# EAGLE board Resistor_Resistor (EAGLE 8.3.0), part 24 of 32
## Placement (x,y rotation side) (continued)
R29212  10K  [0201]  203.35,7.98 0 top
R29213  10K  [0201]  203.35,8.59 0 top
R29214  10K  [0201]  203.35,9.19 0 top
R29215  10K  [0201]  203.35,9.8 0 top
R29216  10K  [0201]  203.35,10.41 0 top
R29217  10K  [0201]  203.35,11.02 0 top
R29218  10K  [0201]  203.35,11.63 0 top
R29219  10K  [0201]  203.35,12.24 0 top
R29220  10K  [0201]  203.35,12.85 0 top
R29221  10K  [0201]  203.35,13.46 0 top
R29222  10K  [0201]  203.35,14.07 0 top
R29223  10K  [0201]  203.35,14.68 0 top
R29224  10K  [0201]  203.35,15.29 0 top
R29225  10K  [0201]  203.35,15.9 0 top
R29226  10K  [0201]  203.35,16.51 0 top
R29227  10K  [0201]  203.35,17.12 0 top
R29228  10K  [0201]  203.35,17.73 0 top
R29229  10K  [0201]  203.35,18.34 0 top
R29230  10K  [0201]  203.35,18.95 0 top
R29231  10K  [0201]  203.35,19.56 0 top
R29232  10K  [0201]  203.35,20.17 0 top
R29233  10K  [0201]  203.35,20.78 0 top
R29234  10K  [0201]  203.35,21.39 0 top
R29235  10K  [0201]  203.35,22 0 top
R29236  10K  [0201]  203.35,22.61 0 top
R29237  10K  [0201]  203.35,23.22 0 top
R29238  10K  [0201]  203.35,23.83 0 top
R29239  10K  [0201]  203.35,24.43 0 top
R29240  10K  [0201]  203.35,25.04 0 top
R29241  10K  [0201]  203.35,25.65 0 top
R29242  10K  [0201]  203.35,26.26 0 top
R29243  10K  [0201]  203.35,26.87 0 top
R29244  10K  [0201]  203.35,27.48 0 top
R29245  10K  [0201]  203.35,28.09 0 top
R29246  10K  [0201]  203.35,28.7 0 top
R29247  10K  [0201]  203.35,29.31 0 top
R29248  10K  [0201]  203.35,29.92 0 top
R29249  10K  [0201]  203.35,30.53 0 top
R29250  10K  [0201]  203.35,31.14 0 top
R29251  10K  [0201]  203.35,31.75 0 top
R29252  10K  [0201]  203.35,32.36 0 top
R29253  10K  [0201]  203.35,32.97 0 top
R29254  10K  [0201]  203.35,33.58 0 top
R29255  10K  [0201]  203.35,34.19 0 top
R29256  10K  [0201]  203.35,34.8 0 top
R29257  10K  [0201]  203.35,35.41 0 top
R29258  10K  [0201]  203.35,36.02 0 top
R29259  10K  [0201]  203.35,36.63 0 top
R29260  10K  [0201]  203.35,37.24 0 top
R29261  10K  [0201]  203.35,37.85 0 top
R29262  10K  [0201]  203.35,38.46 0 top
R29263  10K  [0201]  203.35,39.07 0 top
R29264  10K  [0201]  203.35,39.67 0 top
R29265  10K  [0201]  203.35,40.28 0 top
R29266  10K  [0201]  203.35,40.89 0 top
R29267  10K  [0201]  203.35,41.5 0 top
R29268  10K  [0201]  203.35,42.11 0 top
R29269  10K  [0201]  203.35,42.72 0 top
R29270  10K  [0201]  203.35,43.33 0 top
R29271  10K  [0201]  203.35,43.94 0 top
R29272  10K  [0201]  203.35,44.55 0 top
R29273  10K  [0201]  203.35,45.16 0 top
R29274  10K  [0201]  203.35,45.77 0 top
R29275  10K  [0201]  203.35,46.38 0 top
R29276  10K  [0201]  203.35,46.99 0 top
R29277  10K  [0201]  203.35,47.6 0 top
R29278  10K  [0201]  203.35,48.21 0 top
R29279  10K  [0201]  203.35,48.82 0 top
R29280  10K  [0201]  203.35,49.43 0 top
R29281  10K  [0201]  203.35,50.04 0 top
R29282  10K  [0201]  203.35,50.65 0 top
R29283  10K  [0201]  203.35,51.26 0 top
R29284  10K  [0201]  203.35,51.87 0 top
R29285  10K  [0201]  203.35,52.48 0 top
R29286  10K  [0201]  203.35,53.09 0 top
R29287  10K  [0201]  203.35,53.7 0 top
R29288  10K  [0201]  203.35,54.31 0 top
R29289  10K  [0201]  203.35,54.91 0 top
R29290  10K  [0201]  203.35,55.52 0 top
R29291  10K  [0201]  203.35,56.13 0 top
R29292  10K  [0201]  203.35,56.74 0 top
R29293  10K  [0201]  203.35,57.35 0 top
R29294  10K  [0201]  203.35,57.96 0 top
R29295  10K  [0201]  203.35,58.57 0 top
R29296  10K  [0201]  203.35,59.18 0 top
R29297  10K  [0201]  203.35,59.79 0 top
R29298  10K  [0201]  203.35,60.4 0 top
R29299  10K  [0201]  203.35,61.01 0 top
R29300  10K  [0201]  203.35,61.62 0 top
R29301  10K  [0201]  203.35,62.23 0 top
R29302  10K  [0201]  203.35,62.84 0 top
R29303  10K  [0201]  203.35,63.45 0 top
R29304  10K  [0201]  203.35,64.06 0 top
R29305  10K  [0201]  203.35,64.67 0 top
R29306  10K  [0201]  203.35,65.28 0 top
R29307  10K  [0201]  203.35,65.89 0 top
R29308  10K  [0201]  203.35,66.5 0 top
R29309  10K  [0201]  203.35,67.11 0 top
R29310  10K  [0201]  203.35,67.72 0 top
R29311  10K  [0201]  203.35,68.33 0 top
R29312  10K  [0201]  203.35,68.94 0 top
R29313  10K  [0201]  203.35,69.55 0 top
R29314  10K  [0201]  203.35,70.15 0 top
R29315  10K  [0201]  203.35,70.76 0 top
R29316  10K  [0201]  203.35,71.37 0 top
R29317  10K  [0201]  203.35,71.98 0 top
R29318  10K  [0201]  203.35,72.59 0 top
R29319  10K  [0201]  203.35,73.2 0 top
R29320  10K  [0201]  203.35,73.81 0 top
R29321  10K  [0201]  203.35,74.42 0 top
R29322  10K  [0201]  203.35,75.03 0 top
R29323  10K  [0201]  203.35,75.64 0 top
R29324  10K  [0201]  203.35,76.25 0 top
R29325  10K  [0201]  203.35,76.86 0 top
R29326  10K  [0201]  203.35,77.47 0 top
R29327  10K  [0201]  203.35,78.08 0 top
R29328  10K  [0201]  203.35,78.69 0 top
R29329  10K  [0201]  203.35,79.3 0 top
R29330  10K  [0201]  203.35,79.91 0 top
R29331  10K  [0201]  203.35,80.52 0 top
R29332  10K  [0201]  203.35,81.13 0 top
R29333  10K  [0201]  203.35,81.74 0 top
R29334  10K  [0201]  203.35,82.35 0 top
R29335  10K  [0201]  203.35,82.96 0 top
R29336  10K  [0201]  203.35,83.57 0 top
R29337  10K  [0201]  203.35,84.18 0 top
R29338  10K  [0201]  203.35,84.79 0 top
R29339  10K  [0201]  203.35,85.39 0 top
R29340  10K  [0201]  203.35,86 0 top
R29341  10K  [0201]  203.35,86.61 0 top
R29342  10K  [0201]  203.35,87.22 0 top
R29343  10K  [0201]  203.35,87.83 0 top
R29344  10K  [0201]  203.35,88.44 0 top
R29345  10K  [0201]  203.35,89.05 0 top
R29346  10K  [0201]  203.35,89.66 0 top
R29347  10K  [0201]  203.35,90.27 0 top
R29348  10K  [0201]  203.35,90.88 0 top
R29349  10K  [0201]  203.35,91.49 0 top
R29350  10K  [0201]  203.35,92.1 0 top
R29351  10K  [0201]  203.35,92.71 0 top
R29352  10K  [0201]  203.35,93.32 0 top
R29353  10K  [0201]  203.35,93.93 0 top
R29354  10K  [0201]  203.35,94.54 0 top
R29355  10K  [0201]  203.35,95.15 0 top
R29356  10K  [0201]  203.35,95.76 0 top
R29357  10K  [0201]  203.35,96.37 0 top
R29358  10K  [0201]  203.35,96.98 0 top
R29359  10K  [0201]  203.35,97.59 0 top
R29360  10K  [0201]  203.35,98.2 0 top
R29361  10K  [0201]  203.35,98.81 0 top
R29362  10K  [0201]  203.35,99.42 0 top
R29363  10K  [0201]  203.35,100.03 0 top
R29364  10K  [0201]  203.35,100.63 0 top
R29365  10K  [0201]  203.35,101.24 0 top
R29366  10K  [0201]  203.35,101.85 0 top
R29367  10K  [0201]  203.35,102.46 0 top
R29368  10K  [0201]  203.35,103.07 0 top
R29369  10K  [0201]  203.35,103.68 0 top
R29370  10K  [0201]  203.35,104.29 0 top
R29371  10K  [0201]  203.35,104.9 0 top
R29372  10K  [0201]  203.35,105.51 0 top
R29373  10K  [0201]  203.35,106.12 0 top
R29374  10K  [0201]  203.35,106.73 0 top
R29375  10K  [0201]  203.35,107.34 0 top
R29376  10K  [0201]  203.35,107.95 0 top
R29377  10K  [0201]  203.35,108.56 0 top
R29378  10K  [0201]  203.35,109.17 0 top
R29379  10K  [0201]  203.35,109.78 0 top
R29380  10K  [0201]  203.35,110.39 0 top
R29381  10K  [0201]  203.35,111 0 top
R29382  10K  [0201]  203.35,111.61 0 top
R29383  10K  [0201]  203.35,112.22 0 top
R29384  10K  [0201]  203.35,112.83 0 top
R29385  10K  [0201]  203.35,113.44 0 top
R29386  10K  [0201]  203.35,114.05 0 top
R29387  10K  [0201]  203.35,114.66 0 top
R29388  10K  [0201]  203.35,115.27 0 top
R29389  10K  [0201]  203.35,115.87 0 top
R29390  10K  [0201]  203.35,116.48 0 top
R29391  10K  [0201]  203.35,117.09 0 top
R29392  10K  [0201]  203.35,117.7 0 top
R29393  10K  [0201]  203.35,118.31 0 top
R29394  10K  [0201]  203.35,118.92 0 top
R29395  10K  [0201]  203.35,119.53 0 top
R29396  10K  [0201]  203.35,120.14 0 top
R29397  10K  [0201]  203.35,120.75 0 top
R29398  10K  [0201]  203.35,121.36 0 top
R29399  10K  [0201]  203.35,121.97 0 top
R29400  10K  [0201]  203.35,122.58 0 top
R29401  10K  [0201]  204.57,1.27 0 top
R29402  10K  [0201]  204.57,1.88 0 top
R29403  10K  [0201]  204.57,2.49 0 top
R29404  10K  [0201]  204.57,3.1 0 top
R29405  10K  [0201]  204.57,3.71 0 top
R29406  10K  [0201]  204.57,4.32 0 top
R29407  10K  [0201]  204.57,4.93 0 top
R29408  10K  [0201]  204.57,5.54 0 top
R29409  10K  [0201]  204.57,6.15 0 top
R29410  10K  [0201]  204.57,6.76 0 top
R29411  10K  [0201]  204.57,7.37 0 top
R29412  10K  [0201]  204.57,7.98 0 top
R29413  10K  [0201]  204.57,8.59 0 top
R29414  10K  [0201]  204.57,9.19 0 top
R29415  10K  [0201]  204.57,9.8 0 top
R29416  10K  [0201]  204.57,10.41 0 top
R29417  10K  [0201]  204.57,11.02 0 top
R29418  10K  [0201]  204.57,11.63 0 top
R29419  10K  [0201]  204.57,12.24 0 top
R29420  10K  [0201]  204.57,12.85 0 top
R29421  10K  [0201]  204.57,13.46 0 top
R29422  10K  [0201]  204.57,14.07 0 top
R29423  10K  [0201]  204.57,14.68 0 top
R29424  10K  [0201]  204.57,15.29 0 top
R29425  10K  [0201]  204.57,15.9 0 top
R29426  10K  [0201]  204.57,16.51 0 top
R29427  10K  [0201]  204.57,17.12 0 top
R29428  10K  [0201]  204.57,17.73 0 top
R29429  10K  [0201]  204.57,18.34 0 top
R29430  10K  [0201]  204.57,18.95 0 top
R29431  10K  [0201]  204.57,19.56 0 top
R29432  10K  [0201]  204.57,20.17 0 top
R29433  10K  [0201]  204.57,20.78 0 top
R29434  10K  [0201]  204.57,21.39 0 top
R29435  10K  [0201]  204.57,22 0 top
R29436  10K  [0201]  204.57,22.61 0 top
R29437  10K  [0201]  204.57,23.22 0 top
R29438  10K  [0201]  204.57,23.83 0 top
R29439  10K  [0201]  204.57,24.43 0 top
R29440  10K  [0201]  204.57,25.04 0 top
R29441  10K  [0201]  204.57,25.65 0 top
R29442  10K  [0201]  204.57,26.26 0 top
R29443  10K  [0201]  204.57,26.87 0 top
R29444  10K  [0201]  204.57,27.48 0 top
R29445  10K  [0201]  204.57,28.09 0 top
R29446  10K  [0201]  204.57,28.7 0 top
R29447  10K  [0201]  204.57,29.31 0 top
R29448  10K  [0201]  204.57,29.92 0 top
R29449  10K  [0201]  204.57,30.53 0 top
R29450  10K  [0201]  204.57,31.14 0 top
R29451  10K  [0201]  204.57,31.75 0 top
R29452  10K  [0201]  204.57,32.36 0 top
R29453  10K  [0201]  204.57,32.97 0 top
R29454  10K  [0201]  204.57,33.58 0 top
R29455  10K  [0201]  204.57,34.19 0 top
R29456  10K  [0201]  204.57,34.8 0 top
R29457  10K  [0201]  204.57,35.41 0 top
R29458  10K  [0201]  204.57,36.02 0 top
R29459  10K  [0201]  204.57,36.63 0 top
R29460  10K  [0201]  204.57,37.24 0 top
R29461  10K  [0201]  204.57,37.85 0 top
R29462  10K  [0201]  204.57,38.46 0 top
R29463  10K  [0201]  204.57,39.07 0 top
R29464  10K  [0201]  204.57,39.67 0 top
R29465  10K  [0201]  204.57,40.28 0 top
R29466  10K  [0201]  204.57,40.89 0 top
R29467  10K  [0201]  204.57,41.5 0 top
R29468  10K  [0201]  204.57,42.11 0 top
R29469  10K  [0201]  204.57,42.72 0 top
R29470  10K  [0201]  204.57,43.33 0 top
R29471  10K  [0201]  204.57,43.94 0 top
R29472  10K  [0201]  204.57,44.55 0 top
R29473  10K  [0201]  204.57,45.16 0 top
R29474  10K  [0201]  204.57,45.77 0 top
R29475  10K  [0201]  204.57,46.38 0 top
R29476  10K  [0201]  204.57,46.99 0 top
R29477  10K  [0201]  204.57,47.6 0 top
R29478  10K  [0201]  204.57,48.21 0 top
R29479  10K  [0201]  204.57,48.82 0 top
R29480  10K  [0201]  204.57,49.43 0 top
R29481  10K  [0201]  204.57,50.04 0 top
R29482  10K  [0201]  204.57,50.65 0 top
R29483  10K  [0201]  204.57,51.26 0 top
R29484  10K  [0201]  204.57,51.87 0 top
R29485  10K  [0201]  204.57,52.48 0 top
R29486  10K  [0201]  204.57,53.09 0 top
R29487  10K  [0201]  204.57,53.7 0 top
R29488  10K  [0201]  204.57,54.31 0 top
R29489  10K  [0201]  204.57,54.91 0 top
R29490  10K  [0201]  204.57,55.52 0 top
R29491  10K  [0201]  204.57,56.13 0 top
R29492  10K  [0201]  204.57,56.74 0 top
R29493  10K  [0201]  204.57,57.35 0 top
R29494  10K  [0201]  204.57,57.96 0 top
R29495  10K  [0201]  204.57,58.57 0 top
R29496  10K  [0201]  204.57,59.18 0 top
R29497  10K  [0201]  204.57,59.79 0 top
R29498  10K  [0201]  204.57,60.4 0 top
R29499  10K  [0201]  204.57,61.01 0 top
R29500  10K  [0201]  204.57,61.62 0 top
R29501  10K  [0201]  204.57,62.23 0 top
R29502  10K  [0201]  204.57,62.84 0 top
R29503  10K  [0201]  204.57,63.45 0 top
R29504  10K  [0201]  204.57,64.06 0 top
R29505  10K  [0201]  204.57,64.67 0 top
R29506  10K  [0201]  204.57,65.28 0 top
R29507  10K  [0201]  204.57,65.89 0 top
R29508  10K  [0201]  204.57,66.5 0 top
R29509  10K  [0201]  204.57,67.11 0 top
R29510  10K  [0201]  204.57,67.72 0 top
R29511  10K  [0201]  204.57,68.33 0 top
R29512  10K  [0201]  204.57,68.94 0 top
R29513  10K  [0201]  204.57,69.55 0 top
R29514  10K  [0201]  204.57,70.15 0 top
R29515  10K  [0201]  204.57,70.76 0 top
R29516  10K  [0201]  204.57,71.37 0 top
R29517  10K  [0201]  204.57,71.98 0 top
R29518  10K  [0201]  204.57,72.59 0 top
R29519  10K  [0201]  204.57,73.2 0 top
R29520  10K  [0201]  204.57,73.81 0 top
R29521  10K  [0201]  204.57,74.42 0 top
R29522  10K  [0201]  204.57,75.03 0 top
R29523  10K  [0201]  204.57,75.64 0 top
R29524  10K  [0201]  204.57,76.25 0 top
R29525  10K  [0201]  204.57,76.86 0 top
R29526  10K  [0201]  204.57,77.47 0 top
R29527  10K  [0201]  204.57,78.08 0 top
R29528  10K  [0201]  204.57,78.69 0 top
R29529  10K  [0201]  204.57,79.3 0 top
R29530  10K  [0201]  204.57,79.91 0 top
R29531  10K  [0201]  204.57,80.52 0 top
R29532  10K  [0201]  204.57,81.13 0 top
R29533  10K  [0201]  204.57,81.74 0 top
R29534  10K  [0201]  204.57,82.35 0 top
R29535  10K  [0201]  204.57,82.96 0 top
R29536  10K  [0201]  204.57,83.57 0 top
R29537  10K  [0201]  204.57,84.18 0 top
R29538  10K  [0201]  204.57,84.79 0 top
R29539  10K  [0201]  204.57,85.39 0 top
R29540  10K  [0201]  204.57,86 0 top
R29541  10K  [0201]  204.57,86.61 0 top
R29542  10K  [0201]  204.57,87.22 0 top
R29543  10K  [0201]  204.57,87.83 0 top
R29544  10K  [0201]  204.57,88.44 0 top
R29545  10K  [0201]  204.57,89.05 0 top
R29546  10K  [0201]  204.57,89.66 0 top
R29547  10K  [0201]  204.57,90.27 0 top
R29548  10K  [0201]  204.57,90.88 0 top
R29549  10K  [0201]  204.57,91.49 0 top
R29550  10K  [0201]  204.57,92.1 0 top
R29551  10K  [0201]  204.57,92.71 0 top
R29552  10K  [0201]  204.57,93.32 0 top
R29553  10K  [0201]  204.57,93.93 0 top
R29554  10K  [0201]  204.57,94.54 0 top
R29555  10K  [0201]  204.57,95.15 0 top
R29556  10K  [0201]  204.57,95.76 0 top
R29557  10K  [0201]  204.57,96.37 0 top
R29558  10K  [0201]  204.57,96.98 0 top
R29559  10K  [0201]  204.57,97.59 0 top
R29560  10K  [0201]  204.57,98.2 0 top
R29561  10K  [0201]  204.57,98.81 0 top
R29562  10K  [0201]  204.57,99.42 0 top
R29563  10K  [0201]  204.57,100.03 0 top
R29564  10K  [0201]  204.57,100.63 0 top
R29565  10K  [0201]  204.57,101.24 0 top
R29566  10K  [0201]  204.57,101.85 0 top
R29567  10K  [0201]  204.57,102.46 0 top
R29568  10K  [0201]  204.57,103.07 0 top
R29569  10K  [0201]  204.57,103.68 0 top
R29570  10K  [0201]  204.57,104.29 0 top
R29571  10K  [0201]  204.57,104.9 0 top
R29572  10K  [0201]  204.57,105.51 0 top
R29573  10K  [0201]  204.57,106.12 0 top
R29574  10K  [0201]  204.57,106.73 0 top
R29575  10K  [0201]  204.57,107.34 0 top
R29576  10K  [0201]  204.57,107.95 0 top
R29577  10K  [0201]  204.57,108.56 0 top
R29578  10K  [0201]  204.57,109.17 0 top
R29579  10K  [0201]  204.57,109.78 0 top
R29580  10K  [0201]  204.57,110.39 0 top
R29581  10K  [0201]  204.57,111 0 top
R29582  10K  [0201]  204.57,111.61 0 top
R29583  10K  [0201]  204.57,112.22 0 top
R29584  10K  [0201]  204.57,112.83 0 top
R29585  10K  [0201]  204.57,113.44 0 top
R29586  10K  [0201]  204.57,114.05 0 top
R29587  10K  [0201]  204.57,114.66 0 top
R29588  10K  [0201]  204.57,115.27 0 top
R29589  10K  [0201]  204.57,115.87 0 top
R29590  10K  [0201]  204.57,116.48 0 top
R29591  10K  [0201]  204.57,117.09 0 top
R29592  10K  [0201]  204.57,117.7 0 top
R29593  10K  [0201]  204.57,118.31 0 top
R29594  10K  [0201]  204.57,118.92 0 top
R29595  10K  [0201]  204.57,119.53 0 top
R29596  10K  [0201]  204.57,120.14 0 top
R29597  10K  [0201]  204.57,120.75 0 top
R29598  10K  [0201]  204.57,121.36 0 top
R29599  10K  [0201]  204.57,121.97 0 top
R29600  10K  [0201]  204.57,122.58 0 top
R29601  10K  [0201]  205.79,1.27 0 top
R29602  10K  [0201]  205.79,1.88 0 top
R29603  10K  [0201]  205.79,2.49 0 top
R29604  10K  [0201]  205.79,3.1 0 top
R29605  10K  [0201]  205.79,3.71 0 top
R29606  10K  [0201]  205.79,4.32 0 top
R29607  10K  [0201]  205.79,4.93 0 top
R29608  10K  [0201]  205.79,5.54 0 top
R29609  10K  [0201]  205.79,6.15 0 top
R29610  10K  [0201]  205.79,6.76 0 top
R29611  10K  [0201]  205.79,7.37 0 top
R29612  10K  [0201]  205.79,7.98 0 top
R29613  10K  [0201]  205.79,8.59 0 top
R29614  10K  [0201]  205.79,9.19 0 top
R29615  10K  [0201]  205.79,9.8 0 top
R29616  10K  [0201]  205.79,10.41 0 top
R29617  10K  [0201]  205.79,11.02 0 top
R29618  10K  [0201]  205.79,11.63 0 top
R29619  10K  [0201]  205.79,12.24 0 top
R29620  10K  [0201]  205.79,12.85 0 top
R29621  10K  [0201]  205.79,13.46 0 top
R29622  10K  [0201]  205.79,14.07 0 top
R29623  10K  [0201]  205.79,14.68 0 top
R29624  10K  [0201]  205.79,15.29 0 top
R29625  10K  [0201]  205.79,15.9 0 top
R29626  10K  [0201]  205.79,16.51 0 top
R29627  10K  [0201]  205.79,17.12 0 top
R29628  10K  [0201]  205.79,17.73 0 top
R29629  10K  [0201]  205.79,18.34 0 top
R29630  10K  [0201]  205.79,18.95 0 top
R29631  10K  [0201]  205.79,19.56 0 top
R29632  10K  [0201]  205.79,20.17 0 top
R29633  10K  [0201]  205.79,20.78 0 top
R29634  10K  [0201]  205.79,21.39 0 top
R29635  10K  [0201]  205.79,22 0 top
R29636  10K  [0201]  205.79,22.61 0 top
R29637  10K  [0201]  205.79,23.22 0 top
R29638  10K  [0201]  205.79,23.83 0 top
R29639  10K  [0201]  205.79,24.43 0 top
R29640  10K  [0201]  205.79,25.04 0 top
R29641  10K  [0201]  205.79,25.65 0 top
R29642  10K  [0201]  205.79,26.26 0 top
R29643  10K  [0201]  205.79,26.87 0 top
R29644  10K  [0201]  205.79,27.48 0 top
R29645  10K  [0201]  205.79,28.09 0 top
R29646  10K  [0201]  205.79,28.7 0 top
R29647  10K  [0201]  205.79,29.31 0 top
R29648  10K  [0201]  205.79,29.92 0 top
R29649  10K  [0201]  205.79,30.53 0 top
R29650  10K  [0201]  205.79,31.14 0 top
R29651  10K  [0201]  205.79,31.75 0 top
R29652  10K  [0201]  205.79,32.36 0 top
R29653  10K  [0201]  205.79,32.97 0 top
R29654  10K  [0201]  205.79,33.58 0 top
R29655  10K  [0201]  205.79,34.19 0 top
R29656  10K  [0201]  205.79,34.8 0 top
R29657  10K  [0201]  205.79,35.41 0 top
R29658  10K  [0201]  205.79,36.02 0 top
R29659  10K  [0201]  205.79,36.63 0 top
R29660  10K  [0201]  205.79,37.24 0 top
R29661  10K  [0201]  205.79,37.85 0 top
R29662  10K  [0201]  205.79,38.46 0 top
R29663  10K  [0201]  205.79,39.07 0 top
R29664  10K  [0201]  205.79,39.67 0 top
R29665  10K  [0201]  205.79,40.28 0 top
R29666  10K  [0201]  205.79,40.89 0 top
R29667  10K  [0201]  205.79,41.5 0 top
R29668  10K  [0201]  205.79,42.11 0 top
R29669  10K  [0201]  205.79,42.72 0 top
R29670  10K  [0201]  205.79,43.33 0 top
R29671  10K  [0201]  205.79,43.94 0 top
R29672  10K  [0201]  205.79,44.55 0 top
R29673  10K  [0201]  205.79,45.16 0 top
R29674  10K  [0201]  205.79,45.77 0 top
R29675  10K  [0201]  205.79,46.38 0 top
R29676  10K  [0201]  205.79,46.99 0 top
R29677  10K  [0201]  205.79,47.6 0 top
R29678  10K  [0201]  205.79,48.21 0 top
R29679  10K  [0201]  205.79,48.82 0 top
R29680  10K  [0201]  205.79,49.43 0 top
R29681  10K  [0201]  205.79,50.04 0 top
R29682  10K  [0201]  205.79,50.65 0 top
R29683  10K  [0201]  205.79,51.26 0 top
R29684  10K  [0201]  205.79,51.87 0 top
R29685  10K  [0201]  205.79,52.48 0 top
R29686  10K  [0201]  205.79,53.09 0 top
R29687  10K  [0201]  205.79,53.7 0 top
R29688  10K  [0201]  205.79,54.31 0 top
R29689  10K  [0201]  205.79,54.91 0 top
R29690  10K  [0201]  205.79,55.52 0 top
R29691  10K  [0201]  205.79,56.13 0 top
R29692  10K  [0201]  205.79,56.74 0 top
R29693  10K  [0201]  205.79,57.35 0 top
R29694  10K  [0201]  205.79,57.96 0 top
R29695  10K  [0201]  205.79,58.57 0 top
R29696  10K  [0201]  205.79,59.18 0 top
R29697  10K  [0201]  205.79,59.79 0 top
R29698  10K  [0201]  205.79,60.4 0 top
R29699  10K  [0201]  205.79,61.01 0 top
R29700  10K  [0201]  205.79,61.62 0 top
R29701  10K  [0201]  205.79,62.23 0 top
R29702  10K  [0201]  205.79,62.84 0 top
R29703  10K  [0201]  205.79,63.45 0 top
R29704  10K  [0201]  205.79,64.06 0 top
R29705  10K  [0201]  205.79,64.67 0 top
R29706  10K  [0201]  205.79,65.28 0 top
R29707  10K  [0201]  205.79,65.89 0 top
R29708  10K  [0201]  205.79,66.5 0 top
R29709  10K  [0201]  205.79,67.11 0 top
R29710  10K  [0201]  205.79,67.72 0 top
R29711  10K  [0201]  205.79,68.33 0 top
R29712  10K  [0201]  205.79,68.94 0 top
R29713  10K  [0201]  205.79,69.55 0 top
R29714  10K  [0201]  205.79,70.15 0 top
R29715  10K  [0201]  205.79,70.76 0 top
R29716  10K  [0201]  205.79,71.37 0 top
R29717  10K  [0201]  205.79,71.98 0 top
R29718  10K  [0201]  205.79,72.59 0 top
R29719  10K  [0201]  205.79,73.2 0 top
R29720  10K  [0201]  205.79,73.81 0 top
R29721  10K  [0201]  205.79,74.42 0 top
R29722  10K  [0201]  205.79,75.03 0 top
R29723  10K  [0201]  205.79,75.64 0 top
R29724  10K  [0201]  205.79,76.25 0 top
R29725  10K  [0201]  205.79,76.86 0 top
R29726  10K  [0201]  205.79,77.47 0 top
R29727  10K  [0201]  205.79,78.08 0 top
R29728  10K  [0201]  205.79,78.69 0 top
R29729  10K  [0201]  205.79,79.3 0 top
R29730  10K  [0201]  205.79,79.91 0 top
R29731  10K  [0201]  205.79,80.52 0 top
R29732  10K  [0201]  205.79,81.13 0 top
R29733  10K  [0201]  205.79,81.74 0 top
R29734  10K  [0201]  205.79,82.35 0 top
R29735  10K  [0201]  205.79,82.96 0 top
R29736  10K  [0201]  205.79,83.57 0 top
R29737  10K  [0201]  205.79,84.18 0 top
R29738  10K  [0201]  205.79,84.79 0 top
R29739  10K  [0201]  205.79,85.39 0 top
R29740  10K  [0201]  205.79,86 0 top
R29741  10K  [0201]  205.79,86.61 0 top
R29742  10K  [0201]  205.79,87.22 0 top
R29743  10K  [0201]  205.79,87.83 0 top
R29744  10K  [0201]  205.79,88.44 0 top
R29745  10K  [0201]  205.79,89.05 0 top
R29746  10K  [0201]  205.79,89.66 0 top
R29747  10K  [0201]  205.79,90.27 0 top
R29748  10K  [0201]  205.79,90.88 0 top
R29749  10K  [0201]  205.79,91.49 0 top
R29750  10K  [0201]  205.79,92.1 0 top
R29751  10K  [0201]  205.79,92.71 0 top
R29752  10K  [0201]  205.79,93.32 0 top
R29753  10K  [0201]  205.79,93.93 0 top
R29754  10K  [0201]  205.79,94.54 0 top
R29755  10K  [0201]  205.79,95.15 0 top
R29756  10K  [0201]  205.79,95.76 0 top
R29757  10K  [0201]  205.79,96.37 0 top
R29758  10K  [0201]  205.79,96.98 0 top
R29759  10K  [0201]  205.79,97.59 0 top
R29760  10K  [0201]  205.79,98.2 0 top
R29761  10K  [0201]  205.79,98.81 0 top
R29762  10K  [0201]  205.79,99.42 0 top
R29763  10K  [0201]  205.79,100.03 0 top
R29764  10K  [0201]  205.79,100.63 0 top
R29765  10K  [0201]  205.79,101.24 0 top
R29766  10K  [0201]  205.79,101.85 0 top
R29767  10K  [0201]  205.79,102.46 0 top
R29768  10K  [0201]  205.79,103.07 0 top
R29769  10K  [0201]  205.79,103.68 0 top
R29770  10K  [0201]  205.79,104.29 0 top
R29771  10K  [0201]  205.79,104.9 0 top
R29772  10K  [0201]  205.79,105.51 0 top
R29773  10K  [0201]  205.79,106.12 0 top
R29774  10K  [0201]  205.79,106.73 0 top
R29775  10K  [0201]  205.79,107.34 0 top
R29776  10K  [0201]  205.79,107.95 0 top
R29777  10K  [0201]  205.79,108.56 0 top
R29778  10K  [0201]  205.79,109.17 0 top
R29779  10K  [0201]  205.79,109.78 0 top
R29780  10K  [0201]  205.79,110.39 0 top
R29781  10K  [0201]  205.79,111 0 top
R29782  10K  [0201]  205.79,111.61 0 top
R29783  10K  [0201]  205.79,112.22 0 top
R29784  10K  [0201]  205.79,112.83 0 top
R29785  10K  [0201]  205.79,113.44 0 top
R29786  10K  [0201]  205.79,114.05 0 top
R29787  10K  [0201]  205.79,114.66 0 top
R29788  10K  [0201]  205.79,115.27 0 top
R29789  10K  [0201]  205.79,115.87 0 top
R29790  10K  [0201]  205.79,116.48 0 top
R29791  10K  [0201]  205.79,117.09 0 top
R29792  10K  [0201]  205.79,117.7 0 top
R29793  10K  [0201]  205.79,118.31 0 top
R29794  10K  [0201]  205.79,118.92 0 top
R29795  10K  [0201]  205.79,119.53 0 top
R29796  10K  [0201]  205.79,120.14 0 top
R29797  10K  [0201]  205.79,120.75 0 top
R29798  10K  [0201]  205.79,121.36 0 top
R29799  10K  [0201]  205.79,121.97 0 top
R29800  10K  [0201]  205.79,122.58 0 top
R29801  10K  [0201]  207.01,1.27 0 top
R29802  10K  [0201]  207.01,1.88 0 top
R29803  10K  [0201]  207.01,2.49 0 top
R29804  10K  [0201]  207.01,3.1 0 top
R29805  10K  [0201]  207.01,3.71 0 top
R29806  10K  [0201]  207.01,4.32 0 top
R29807  10K  [0201]  207.01,4.93 0 top
R29808  10K  [0201]  207.01,5.54 0 top
R29809  10K  [0201]  207.01,6.15 0 top
R29810  10K  [0201]  207.01,6.76 0 top
R29811  10K  [0201]  207.01,7.37 0 top
R29812  10K  [0201]  207.01,7.98 0 top
R29813  10K  [0201]  207.01,8.59 0 top
R29814  10K  [0201]  207.01,9.19 0 top
R29815  10K  [0201]  207.01,9.8 0 top
R29816  10K  [0201]  207.01,10.41 0 top
R29817  10K  [0201]  207.01,11.02 0 top
R29818  10K  [0201]  207.01,11.63 0 top
R29819  10K  [0201]  207.01,12.24 0 top
R29820  10K  [0201]  207.01,12.85 0 top
R29821  10K  [0201]  207.01,13.46 0 top
R29822  10K  [0201]  207.01,14.07 0 top
R29823  10K  [0201]  207.01,14.68 0 top
R29824  10K  [0201]  207.01,15.29 0 top
R29825  10K  [0201]  207.01,15.9 0 top
R29826  10K  [0201]  207.01,16.51 0 top
R29827  10K  [0201]  207.01,17.12 0 top
R29828  10K  [0201]  207.01,17.73 0 top
R29829  10K  [0201]  207.01,18.34 0 top
R29830  10K  [0201]  207.01,18.95 0 top
R29831  10K  [0201]  207.01,19.56 0 top
R29832  10K  [0201]  207.01,20.17 0 top
R29833  10K  [0201]  207.01,20.78 0 top
R29834  10K  [0201]  207.01,21.39 0 top
R29835  10K  [0201]  207.01,22 0 top
R29836  10K  [0201]  207.01,22.61 0 top
R29837  10K  [0201]  207.01,23.22 0 top
R29838  10K  [0201]  207.01,23.83 0 top
R29839  10K  [0201]  207.01,24.43 0 top
R29840  10K  [0201]  207.01,25.04 0 top
R29841  10K  [0201]  207.01,25.65 0 top
R29842  10K  [0201]  207.01,26.26 0 top
R29843  10K  [0201]  207.01,26.87 0 top
R29844  10K  [0201]  207.01,27.48 0 top
R29845  10K  [0201]  207.01,28.09 0 top
R29846  10K  [0201]  207.01,28.7 0 top
R29847  10K  [0201]  207.01,29.31 0 top
R29848  10K  [0201]  207.01,29.92 0 top
R29849  10K  [0201]  207.01,30.53 0 top
R29850  10K  [0201]  207.01,31.14 0 top
R29851  10K  [0201]  207.01,31.75 0 top
R29852  10K  [0201]  207.01,32.36 0 top
R29853  10K  [0201]  207.01,32.97 0 top
R29854  10K  [0201]  207.01,33.58 0 top
R29855  10K  [0201]  207.01,34.19 0 top
R29856  10K  [0201]  207.01,34.8 0 top
R29857  10K  [0201]  207.01,35.41 0 top
R29858  10K  [0201]  207.01,36.02 0 top
R29859  10K  [0201]  207.01,36.63 0 top
R29860  10K  [0201]  207.01,37.24 0 top
R29861  10K  [0201]  207.01,37.85 0 top
R29862  10K  [0201]  207.01,38.46 0 top
R29863  10K  [0201]  207.01,39.07 0 top
R29864  10K  [0201]  207.01,39.67 0 top
R29865  10K  [0201]  207.01,40.28 0 top
R29866  10K  [0201]  207.01,40.89 0 top
R29867  10K  [0201]  207.01,41.5 0 top
R29868  10K  [0201]  207.01,42.11 0 top
R29869  10K  [0201]  207.01,42.72 0 top
R29870  10K  [0201]  207.01,43.33 0 top
R29871  10K  [0201]  207.01,43.94 0 top
R29872  10K  [0201]  207.01,44.55 0 top
R29873  10K  [0201]  207.01,45.16 0 top
R29874  10K  [0201]  207.01,45.77 0 top
R29875  10K  [0201]  207.01,46.38 0 top
R29876  10K  [0201]  207.01,46.99 0 top
R29877  10K  [0201]  207.01,47.6 0 top
R29878  10K  [0201]  207.01,48.21 0 top
R29879  10K  [0201]  207.01,48.82 0 top
R29880  10K  [0201]  207.01,49.43 0 top
R29881  10K  [0201]  207.01,50.04 0 top
R29882  10K  [0201]  207.01,50.65 0 top
R29883  10K  [0201]  207.01,51.26 0 top
R29884  10K  [0201]  207.01,51.87 0 top
R29885  10K  [0201]  207.01,52.48 0 top
R29886  10K  [0201]  207.01,53.09 0 top
R29887  10K  [0201]  207.01,53.7 0 top
R29888  10K  [0201]  207.01,54.31 0 top
R29889  10K  [0201]  207.01,54.91 0 top
R29890  10K  [0201]  207.01,55.52 0 top
R29891  10K  [0201]  207.01,56.13 0 top
R29892  10K  [0201]  207.01,56.74 0 top
R29893  10K  [0201]  207.01,57.35 0 top
R29894  10K  [0201]  207.01,57.96 0 top
R29895  10K  [0201]  207.01,58.57 0 top
R29896  10K  [0201]  207.01,59.18 0 top
R29897  10K  [0201]  207.01,59.79 0 top
R29898  10K  [0201]  207.01,60.4 0 top
R29899  10K  [0201]  207.01,61.01 0 top
R29900  10K  [0201]  207.01,61.62 0 top
R29901  10K  [0201]  207.01,62.23 0 top
R29902  10K  [0201]  207.01,62.84 0 top
R29903  10K  [0201]  207.01,63.45 0 top
R29904  10K  [0201]  207.01,64.06 0 top
R29905  10K  [0201]  207.01,64.67 0 top
R29906  10K  [0201]  207.01,65.28 0 top
R29907  10K  [0201]  207.01,65.89 0 top
R29908  10K  [0201]  207.01,66.5 0 top
R29909  10K  [0201]  207.01,67.11 0 top
R29910  10K  [0201]  207.01,67.72 0 top
R29911  10K  [0201]  207.01,68.33 0 top
R29912  10K  [0201]  207.01,68.94 0 top
R29913  10K  [0201]  207.01,69.55 0 top
R29914  10K  [0201]  207.01,70.15 0 top
R29915  10K  [0201]  207.01,70.76 0 top
R29916  10K  [0201]  207.01,71.37 0 top
R29917  10K  [0201]  207.01,71.98 0 top
R29918  10K  [0201]  207.01,72.59 0 top
R29919  10K  [0201]  207.01,73.2 0 top
R29920  10K  [0201]  207.01,73.81 0 top
R29921  10K  [0201]  207.01,74.42 0 top
R29922  10K  [0201]  207.01,75.03 0 top
R29923  10K  [0201]  207.01,75.64 0 top
R29924  10K  [0201]  207.01,76.25 0 top
R29925  10K  [0201]  207.01,76.86 0 top
R29926  10K  [0201]  207.01,77.47 0 top
R29927  10K  [0201]  207.01,78.08 0 top
R29928  10K  [0201]  207.01,78.69 0 top
R29929  10K  [0201]  207.01,79.3 0 top
R29930  10K  [0201]  207.01,79.91 0 top
R29931  10K  [0201]  207.01,80.52 0 top
R29932  10K  [0201]  207.01,81.13 0 top
R29933  10K  [0201]  207.01,81.74 0 top
R29934  10K  [0201]  207.01,82.35 0 top
R29935  10K  [0201]  207.01,82.96 0 top
R29936  10K  [0201]  207.01,83.57 0 top
R29937  10K  [0201]  207.01,84.18 0 top
R29938  10K  [0201]  207.01,84.79 0 top
R29939  10K  [0201]  207.01,85.39 0 top
R29940  10K  [0201]  207.01,86 0 top
R29941  10K  [0201]  207.01,86.61 0 top
R29942  10K  [0201]  207.01,87.22 0 top
R29943  10K  [0201]  207.01,87.83 0 top
R29944  10K  [0201]  207.01,88.44 0 top
R29945  10K  [0201]  207.01,89.05 0 top
R29946  10K  [0201]  207.01,89.66 0 top
R29947  10K  [0201]  207.01,90.27 0 top
R29948  10K  [0201]  207.01,90.88 0 top
R29949  10K  [0201]  207.01,91.49 0 top
R29950  10K  [0201]  207.01,92.1 0 top
R29951  10K  [0201]  207.01,92.71 0 top
R29952  10K  [0201]  207.01,93.32 0 top
R29953  10K  [0201]  207.01,93.93 0 top
R29954  10K  [0201]  207.01,94.54 0 top
R29955  10K  [0201]  207.01,95.15 0 top
R29956  10K  [0201]  207.01,95.76 0 top
R29957  10K  [0201]  207.01,96.37 0 top
R29958  10K  [0201]  207.01,96.98 0 top
R29959  10K  [0201]  207.01,97.59 0 top
R29960  10K  [0201]  207.01,98.2 0 top
R29961  10K  [0201]  207.01,98.81 0 top
R29962  10K  [0201]  207.01,99.42 0 top
R29963  10K  [0201]  207.01,100.03 0 top
R29964  10K  [0201]  207.01,100.63 0 top
R29965  10K  [0201]  207.01,101.24 0 top
R29966  10K  [0201]  207.01,101.85 0 top
R29967  10K  [0201]  207.01,102.46 0 top
R29968  10K  [0201]  207.01,103.07 0 top
R29969  10K  [0201]  207.01,103.68 0 top
R29970  10K  [0201]  207.01,104.29 0 top
R29971  10K  [0201]  207.01,104.9 0 top
R29972  10K  [0201]  207.01,105.51 0 top
R29973  10K  [0201]  207.01,106.12 0 top
R29974  10K  [0201]  207.01,106.73 0 top
R29975  10K  [0201]  207.01,107.34 0 top
R29976  10K  [0201]  207.01,107.95 0 top
R29977  10K  [0201]  207.01,108.56 0 top
R29978  10K  [0201]  207.01,109.17 0 top
R29979  10K  [0201]  207.01,109.78 0 top
R29980  10K  [0201]  207.01,110.39 0 top
R29981  10K  [0201]  207.01,111 0 top
R29982  10K  [0201]  207.01,111.61 0 top
R29983  10K  [0201]  207.01,112.22 0 top
R29984  10K  [0201]  207.01,112.83 0 top
R29985  10K  [0201]  207.01,113.44 0 top
R29986  10K  [0201]  207.01,114.05 0 top
R29987  10K  [0201]  207.01,114.66 0 top
R29988  10K  [0201]  207.01,115.27 0 top
R29989  10K  [0201]  207.01,115.87 0 top
R29990  10K  [0201]  207.01,116.48 0 top
R29991  10K  [0201]  207.01,117.09 0 top
R29992  10K  [0201]  207.01,117.7 0 top
R29993  10K  [0201]  207.01,118.31 0 top
R29994  10K  [0201]  207.01,118.92 0 top
R29995  10K  [0201]  207.01,119.53 0 top
R29996  10K  [0201]  207.01,120.14 0 top
R29997  10K  [0201]  207.01,120.75 0 top
R29998  10K  [0201]  207.01,121.36 0 top
R29999  10K  [0201]  207.01,121.97 0 top
R30000  10K  [0201]  207.01,122.58 0 top
R30001  10K  [0201]  208.23,1.27 0 top
R30002  10K  [0201]  208.23,1.88 0 top
R30003  10K  [0201]  208.23,2.49 0 top
R30004  10K  [0201]  208.23,3.1 0 top
R30005  10K  [0201]  208.23,3.71 0 top
R30006  10K  [0201]  208.23,4.32 0 top
R30007  10K  [0201]  208.23,4.93 0 top
R30008  10K  [0201]  208.23,5.54 0 top
R30009  10K  [0201]  208.23,6.15 0 top
R30010  10K  [0201]  208.23,6.76 0 top
R30011  10K  [0201]  208.23,7.37 0 top
R30012  10K  [0201]  208.23,7.98 0 top
R30013  10K  [0201]  208.23,8.59 0 top
R30014  10K  [0201]  208.23,9.19 0 top
R30015  10K  [0201]  208.23,9.8 0 top
R30016  10K  [0201]  208.23,10.41 0 top
R30017  10K  [0201]  208.23,11.02 0 top
R30018  10K  [0201]  208.23,11.63 0 top
R30019  10K  [0201]  208.23,12.24 0 top
R30020  10K  [0201]  208.23,12.85 0 top
R30021  10K  [0201]  208.23,13.46 0 top
R30022  10K  [0201]  208.23,14.07 0 top
R30023  10K  [0201]  208.23,14.68 0 top
R30024  10K  [0201]  208.23,15.29 0 top
R30025  10K  [0201]  208.23,15.9 0 top
R30026  10K  [0201]  208.23,16.51 0 top
R30027  10K  [0201]  208.23,17.12 0 top
R30028  10K  [0201]  208.23,17.73 0 top
R30029  10K  [0201]  208.23,18.34 0 top
R30030  10K  [0201]  208.23,18.95 0 top
R30031  10K  [0201]  208.23,19.56 0 top
R30032  10K  [0201]  208.23,20.17 0 top
R30033  10K  [0201]  208.23,20.78 0 top
R30034  10K  [0201]  208.23,21.39 0 top
R30035  10K  [0201]  208.23,22 0 top
R30036  10K  [0201]  208.23,22.61 0 top
R30037  10K  [0201]  208.23,23.22 0 top
R30038  10K  [0201]  208.23,23.83 0 top
R30039  10K  [0201]  208.23,24.43 0 top
R30040  10K  [0201]  208.23,25.04 0 top
R30041  10K  [0201]  208.23,25.65 0 top
R30042  10K  [0201]  208.23,26.26 0 top
R30043  10K  [0201]  208.23,26.87 0 top
R30044  10K  [0201]  208.23,27.48 0 top
R30045  10K  [0201]  208.23,28.09 0 top
R30046  10K  [0201]  208.23,28.7 0 top
R30047  10K  [0201]  208.23,29.31 0 top
R30048  10K  [0201]  208.23,29.92 0 top
R30049  10K  [0201]  208.23,30.53 0 top
R30050  10K  [0201]  208.23,31.14 0 top
R30051  10K  [0201]  208.23,31.75 0 top
R30052  10K  [0201]  208.23,32.36 0 top
R30053  10K  [0201]  208.23,32.97 0 top
R30054  10K  [0201]  208.23,33.58 0 top
R30055  10K  [0201]  208.23,34.19 0 top
R30056  10K  [0201]  208.23,34.8 0 top
R30057  10K  [0201]  208.23,35.41 0 top
R30058  10K  [0201]  208.23,36.02 0 top
R30059  10K  [0201]  208.23,36.63 0 top
R30060  10K  [0201]  208.23,37.24 0 top
R30061  10K  [0201]  208.23,37.85 0 top
R30062  10K  [0201]  208.23,38.46 0 top
R30063  10K  [0201]  208.23,39.07 0 top
R30064  10K  [0201]  208.23,39.67 0 top
R30065  10K  [0201]  208.23,40.28 0 top
R30066  10K  [0201]  208.23,40.89 0 top
R30067  10K  [0201]  208.23,41.5 0 top
R30068  10K  [0201]  208.23,42.11 0 top
R30069  10K  [0201]  208.23,42.72 0 top
R30070  10K  [0201]  208.23,43.33 0 top
R30071  10K  [0201]  208.23,43.94 0 top
R30072  10K  [0201]  208.23,44.55 0 top
R30073  10K  [0201]  208.23,45.16 0 top
R30074  10K  [0201]  208.23,45.77 0 top
R30075  10K  [0201]  208.23,46.38 0 top
R30076  10K  [0201]  208.23,46.99 0 top
R30077  10K  [0201]  208.23,47.6 0 top
R30078  10K  [0201]  208.23,48.21 0 top
R30079  10K  [0201]  208.23,48.82 0 top
R30080  10K  [0201]  208.23,49.43 0 top
R30081  10K  [0201]  208.23,50.04 0 top
R30082  10K  [0201]  208.23,50.65 0 top
R30083  10K  [0201]  208.23,51.26 0 top
R30084  10K  [0201]  208.23,51.87 0 top
R30085  10K  [0201]  208.23,52.48 0 top
R30086  10K  [0201]  208.23,53.09 0 top
R30087  10K  [0201]  208.23,53.7 0 top
R30088  10K  [0201]  208.23,54.31 0 top
R30089  10K  [0201]  208.23,54.91 0 top
R30090  10K  [0201]  208.23,55.52 0 top
R30091  10K  [0201]  208.23,56.13 0 top
R30092  10K  [0201]  208.23,56.74 0 top
R30093  10K  [0201]  208.23,57.35 0 top
R30094  10K  [0201]  208.23,57.96 0 top
R30095  10K  [0201]  208.23,58.57 0 top
R30096  10K  [0201]  208.23,59.18 0 top
R30097  10K  [0201]  208.23,59.79 0 top
R30098  10K  [0201]  208.23,60.4 0 top
R30099  10K  [0201]  208.23,61.01 0 top
R30100  10K  [0201]  208.23,61.62 0 top
R30101  10K  [0201]  208.23,62.23 0 top
R30102  10K  [0201]  208.23,62.84 0 top
R30103  10K  [0201]  208.23,63.45 0 top
R30104  10K  [0201]  208.23,64.06 0 top
R30105  10K  [0201]  208.23,64.67 0 top
R30106  10K  [0201]  208.23,65.28 0 top
R30107  10K  [0201]  208.23,65.89 0 top
R30108  10K  [0201]  208.23,66.5 0 top
R30109  10K  [0201]  208.23,67.11 0 top
R30110  10K  [0201]  208.23,67.72 0 top
R30111  10K  [0201]  208.23,68.33 0 top
R30112  10K  [0201]  208.23,68.94 0 top
R30113  10K  [0201]  208.23,69.55 0 top
R30114  10K  [0201]  208.23,70.15 0 top
R30115  10K  [0201]  208.23,70.76 0 top
R30116  10K  [0201]  208.23,71.37 0 top
R30117  10K  [0201]  208.23,71.98 0 top
R30118  10K  [0201]  208.23,72.59 0 top
R30119  10K  [0201]  208.23,73.2 0 top
R30120  10K  [0201]  208.23,73.81 0 top
R30121  10K  [0201]  208.23,74.42 0 top
R30122  10K  [0201]  208.23,75.03 0 top
R30123  10K  [0201]  208.23,75.64 0 top
R30124  10K  [0201]  208.23,76.25 0 top
R30125  10K  [0201]  208.23,76.86 0 top
R30126  10K  [0201]  208.23,77.47 0 top
R30127  10K  [0201]  208.23,78.08 0 top
R30128  10K  [0201]  208.23,78.69 0 top
R30129  10K  [0201]  208.23,79.3 0 top
R30130  10K  [0201]  208.23,79.91 0 top
R30131  10K  [0201]  208.23,80.52 0 top
R30132  10K  [0201]  208.23,81.13 0 top
R30133  10K  [0201]  208.23,81.74 0 top
R30134  10K  [0201]  208.23,82.35 0 top
R30135  10K  [0201]  208.23,82.96 0 top
R30136  10K  [0201]  208.23,83.57 0 top
R30137  10K  [0201]  208.23,84.18 0 top
R30138  10K  [0201]  208.23,84.79 0 top
R30139  10K  [0201]  208.23,85.39 0 top
R30140  10K  [0201]  208.23,86 0 top
R30141  10K  [0201]  208.23,86.61 0 top
R30142  10K  [0201]  208.23,87.22 0 top
R30143  10K  [0201]  208.23,87.83 0 top
R30144  10K  [0201]  208.23,88.44 0 top
R30145  10K  [0201]  208.23,89.05 0 top
R30146  10K  [0201]  208.23,89.66 0 top
R30147  10K  [0201]  208.23,90.27 0 top
R30148  10K  [0201]  208.23,90.88 0 top
R30149  10K  [0201]  208.23,91.49 0 top
R30150  10K  [0201]  208.23,92.1 0 top
R30151  10K  [0201]  208.23,92.71 0 top
R30152  10K  [0201]  208.23,93.32 0 top
R30153  10K  [0201]  208.23,93.93 0 top
R30154  10K  [0201]  208.23,94.54 0 top
R30155  10K  [0201]  208.23,95.15 0 top
R30156  10K  [0201]  208.23,95.76 0 top
R30157  10K  [0201]  208.23,96.37 0 top
R30158  10K  [0201]  208.23,96.98 0 top
R30159  10K  [0201]  208.23,97.59 0 top
R30160  10K  [0201]  208.23,98.2 0 top
R30161  10K  [0201]  208.23,98.81 0 top
R30162  10K  [0201]  208.23,99.42 0 top
R30163  10K  [0201]  208.23,100.03 0 top
R30164  10K  [0201]  208.23,100.63 0 top
R30165  10K  [0201]  208.23,101.24 0 top
R30166  10K  [0201]  208.23,101.85 0 top
R30167  10K  [0201]  208.23,102.46 0 top
R30168  10K  [0201]  208.23,103.07 0 top
R30169  10K  [0201]  208.23,103.68 0 top
R30170  10K  [0201]  208.23,104.29 0 top
R30171  10K  [0201]  208.23,104.9 0 top
R30172  10K  [0201]  208.23,105.51 0 top
R30173  10K  [0201]  208.23,106.12 0 top
R30174  10K  [0201]  208.23,106.73 0 top
R30175  10K  [0201]  208.23,107.34 0 top
R30176  10K  [0201]  208.23,107.95 0 top
R30177  10K  [0201]  208.23,108.56 0 top
R30178  10K  [0201]  208.23,109.17 0 top
R30179  10K  [0201]  208.23,109.78 0 top
R30180  10K  [0201]  208.23,110.39 0 top
R30181  10K  [0201]  208.23,111 0 top
R30182  10K  [0201]  208.23,111.61 0 top
R30183  10K  [0201]  208.23,112.22 0 top
R30184  10K  [0201]  208.23,112.83 0 top
R30185  10K  [0201]  208.23,113.44 0 top
R30186  10K  [0201]  208.23,114.05 0 top
R30187  10K  [0201]  208.23,114.66 0 top
R30188  10K  [0201]  208.23,115.27 0 top
R30189  10K  [0201]  208.23,115.87 0 top
R30190  10K  [0201]  208.23,116.48 0 top
R30191  10K  [0201]  208.23,117.09 0 top
R30192  10K  [0201]  208.23,117.7 0 top
R30193  10K  [0201]  208.23,118.31 0 top
R30194  10K  [0201]  208.23,118.92 0 top
R30195  10K  [0201]  208.23,119.53 0 top
R30196  10K  [0201]  208.23,120.14 0 top
R30197  10K  [0201]  208.23,120.75 0 top
R30198  10K  [0201]  208.23,121.36 0 top
R30199  10K  [0201]  208.23,121.97 0 top
R30200  10K  [0201]  208.23,122.58 0 top
R30201  10K  [0201]  209.45,1.27 0 top
R30202  10K  [0201]  209.45,1.88 0 top
R30203  10K  [0201]  209.45,2.49 0 top
R30204  10K  [0201]  209.45,3.1 0 top
R30205  10K  [0201]  209.45,3.71 0 top
R30206  10K  [0201]  209.45,4.32 0 top
R30207  10K  [0201]  209.45,4.93 0 top
R30208  10K  [0201]  209.45,5.54 0 top
R30209  10K  [0201]  209.45,6.15 0 top
R30210  10K  [0201]  209.45,6.76 0 top
R30211  10K  [0201]  209.45,7.37 0 top
R30212  10K  [0201]  209.45,7.98 0 top
R30213  10K  [0201]  209.45,8.59 0 top
R30214  10K  [0201]  209.45,9.19 0 top
R30215  10K  [0201]  209.45,9.8 0 top
R30216  10K  [0201]  209.45,10.41 0 top
R30217  10K  [0201]  209.45,11.02 0 top
R30218  10K  [0201]  209.45,11.63 0 top
R30219  10K  [0201]  209.45,12.24 0 top
R30220  10K  [0201]  209.45,12.85 0 top
R30221  10K  [0201]  209.45,13.46 0 top
R30222  10K  [0201]  209.45,14.07 0 top
R30223  10K  [0201]  209.45,14.68 0 top
R30224  10K  [0201]  209.45,15.29 0 top
R30225  10K  [0201]  209.45,15.9 0 top
R30226  10K  [0201]  209.45,16.51 0 top
R30227  10K  [0201]  209.45,17.12 0 top
R30228  10K  [0201]  209.45,17.73 0 top
R30229  10K  [0201]  209.45,18.34 0 top
R30230  10K  [0201]  209.45,18.95 0 top
R30231  10K  [0201]  209.45,19.56 0 top
R30232  10K  [0201]  209.45,20.17 0 top
R30233  10K  [0201]  209.45,20.78 0 top
R30234  10K  [0201]  209.45,21.39 0 top
R30235  10K  [0201]  209.45,22 0 top
R30236  10K  [0201]  209.45,22.61 0 top
R30237  10K  [0201]  209.45,23.22 0 top
R30238  10K  [0201]  209.45,23.83 0 top
R30239  10K  [0201]  209.45,24.43 0 top
R30240  10K  [0201]  209.45,25.04 0 top
R30241  10K  [0201]  209.45,25.65 0 top
R30242  10K  [0201]  209.45,26.26 0 top
R30243  10K  [0201]  209.45,26.87 0 top
R30244  10K  [0201]  209.45,27.48 0 top
R30245  10K  [0201]  209.45,28.09 0 top
R30246  10K  [0201]  209.45,28.7 0 top
R30247  10K  [0201]  209.45,29.31 0 top
R30248  10K  [0201]  209.45,29.92 0 top
R30249  10K  [0201]  209.45,30.53 0 top
R30250  10K  [0201]  209.45,31.14 0 top
R30251  10K  [0201]  209.45,31.75 0 top
R30252  10K  [0201]  209.45,32.36 0 top
R30253  10K  [0201]  209.45,32.97 0 top
R30254  10K  [0201]  209.45,33.58 0 top
R30255  10K  [0201]  209.45,34.19 0 top
R30256  10K  [0201]  209.45,34.8 0 top
R30257  10K  [0201]  209.45,35.41 0 top
R30258  10K  [0201]  209.45,36.02 0 top
R30259  10K  [0201]  209.45,36.63 0 top
R30260  10K  [0201]  209.45,37.24 0 top
R30261  10K  [0201]  209.45,37.85 0 top
R30262  10K  [0201]  209.45,38.46 0 top
R30263  10K  [0201]  209.45,39.07 0 top
R30264  10K  [0201]  209.45,39.67 0 top
R30265  10K  [0201]  209.45,40.28 0 top
R30266  10K  [0201]  209.45,40.89 0 top
R30267  10K  [0201]  209.45,41.5 0 top
R30268  10K  [0201]  209.45,42.11 0 top
R30269  10K  [0201]  209.45,42.72 0 top
R30270  10K  [0201]  209.45,43.33 0 top
R30271  10K  [0201]  209.45,43.94 0 top
R30272  10K  [0201]  209.45,44.55 0 top
R30273  10K  [0201]  209.45,45.16 0 top
R30274  10K  [0201]  209.45,45.77 0 top
R30275  10K  [0201]  209.45,46.38 0 top
R30276  10K  [0201]  209.45,46.99 0 top
R30277  10K  [0201]  209.45,47.6 0 top
R30278  10K  [0201]  209.45,48.21 0 top
R30279  10K  [0201]  209.45,48.82 0 top
R30280  10K  [0201]  209.45,49.43 0 top
R30281  10K  [0201]  209.45,50.04 0 top
R30282  10K  [0201]  209.45,50.65 0 top
R30283  10K  [0201]  209.45,51.26 0 top
R30284  10K  [0201]  209.45,51.87 0 top
R30285  10K  [0201]  209.45,52.48 0 top
R30286  10K  [0201]  209.45,53.09 0 top
R30287  10K  [0201]  209.45,53.7 0 top
R30288  10K  [0201]  209.45,54.31 0 top
R30289  10K  [0201]  209.45,54.91 0 top
R30290  10K  [0201]  209.45,55.52 0 top
R30291  10K  [0201]  209.45,56.13 0 top
R30292  10K  [0201]  209.45,56.74 0 top
R30293  10K  [0201]  209.45,57.35 0 top
R30294  10K  [0201]  209.45,57.96 0 top
R30295  10K  [0201]  209.45,58.57 0 top
R30296  10K  [0201]  209.45,59.18 0 top
R30297  10K  [0201]  209.45,59.79 0 top
R30298  10K  [0201]  209.45,60.4 0 top
R30299  10K  [0201]  209.45,61.01 0 top
R30300  10K  [0201]  209.45,61.62 0 top
R30301  10K  [0201]  209.45,62.23 0 top
R30302  10K  [0201]  209.45,62.84 0 top
R30303  10K  [0201]  209.45,63.45 0 top
R30304  10K  [0201]  209.45,64.06 0 top
R30305  10K  [0201]  209.45,64.67 0 top
R30306  10K  [0201]  209.45,65.28 0 top
R30307  10K  [0201]  209.45,65.89 0 top
R30308  10K  [0201]  209.45,66.5 0 top
R30309  10K  [0201]  209.45,67.11 0 top
R30310  10K  [0201]  209.45,67.72 0 top
R30311  10K  [0201]  209.45,68.33 0 top
R30312  10K  [0201]  209.45,68.94 0 top
R30313  10K  [0201]  209.45,69.55 0 top
R30314  10K  [0201]  209.45,70.15 0 top
R30315  10K  [0201]  209.45,70.76 0 top
R30316  10K  [0201]  209.45,71.37 0 top
R30317  10K  [0201]  209.45,71.98 0 top
R30318  10K  [0201]  209.45,72.59 0 top
R30319  10K  [0201]  209.45,73.2 0 top
R30320  10K  [0201]  209.45,73.81 0 top
R30321  10K  [0201]  209.45,74.42 0 top
R30322  10K  [0201]  209.45,75.03 0 top
R30323  10K  [0201]  209.45,75.64 0 top
R30324  10K  [0201]  209.45,76.25 0 top
R30325  10K  [0201]  209.45,76.86 0 top
R30326  10K  [0201]  209.45,77.47 0 top
R30327  10K  [0201]  209.45,78.08 0 top
R30328  10K  [0201]  209.45,78.69 0 top
R30329  10K  [0201]  209.45,79.3 0 top
R30330  10K  [0201]  209.45,79.91 0 top
R30331  10K  [0201]  209.45,80.52 0 top
R30332  10K  [0201]  209.45,81.13 0 top
R30333  10K  [0201]  209.45,81.74 0 top
R30334  10K  [0201]  209.45,82.35 0 top
R30335  10K  [0201]  209.45,82.96 0 top
R30336  10K  [0201]  209.45,83.57 0 top
R30337  10K  [0201]  209.45,84.18 0 top
R30338  10K  [0201]  209.45,84.79 0 top
R30339  10K  [0201]  209.45,85.39 0 top
R30340  10K  [0201]  209.45,86 0 top
R30341  10K  [0201]  209.45,86.61 0 top
R30342  10K  [0201]  209.45,87.22 0 top
R30343  10K  [0201]  209.45,87.83 0 top
R30344  10K  [0201]  209.45,88.44 0 top
R30345  10K  [0201]  209.45,89.05 0 top
R30346  10K  [0201]  209.45,89.66 0 top
R30347  10K  [0201]  209.45,90.27 0 top
R30348  10K  [0201]  209.45,90.88 0 top
R30349  10K  [0201]  209.45,91.49 0 top
R30350  10K  [0201]  209.45,92.1 0 top
R30351  10K  [0201]  209.45,92.71 0 top
R30352  10K  [0201]  209.45,93.32 0 top
R30353  10K  [0201]  209.45,93.93 0 top
R30354  10K  [0201]  209.45,94.54 0 top
R30355  10K  [0201]  209.45,95.15 0 top
R30356  10K  [0201]  209.45,95.76 0 top
R30357  10K  [0201]  209.45,96.37 0 top
R30358  10K  [0201]  209.45,96.98 0 top
R30359  10K  [0201]  209.45,97.59 0 top
R30360  10K  [0201]  209.45,98.2 0 top
R30361  10K  [0201]  209.45,98.81 0 top
R30362  10K  [0201]  209.45,99.42 0 top
R30363  10K  [0201]  209.45,100.03 0 top
R30364  10K  [0201]  209.45,100.63 0 top
R30365  10K  [0201]  209.45,101.24 0 top
R30366  10K  [0201]  209.45,101.85 0 top
R30367  10K  [0201]  209.45,102.46 0 top
R30368  10K  [0201]  209.45,103.07 0 top
R30369  10K  [0201]  209.45,103.68 0 top
R30370  10K  [0201]  209.45,104.29 0 top
R30371  10K  [0201]  209.45,104.9 0 top
R30372  10K  [0201]  209.45,105.51 0 top
R30373  10K  [0201]  209.45,106.12 0 top
R30374  10K  [0201]  209.45,106.73 0 top
R30375  10K  [0201]  209.45,107.34 0 top
R30376  10K  [0201]  209.45,107.95 0 top
R30377  10K  [0201]  209.45,108.56 0 top
R30378  10K  [0201]  209.45,109.17 0 top
R30379  10K  [0201]  209.45,109.78 0 top
R30380  10K  [0201]  209.45,110.39 0 top
R30381  10K  [0201]  209.45,111 0 top
R30382  10K  [0201]  209.45,111.61 0 top
R30383  10K  [0201]  209.45,112.22 0 top
R30384  10K  [0201]  209.45,112.83 0 top
R30385  10K  [0201]  209.45,113.44 0 top
R30386  10K  [0201]  209.45,114.05 0 top
R30387  10K  [0201]  209.45,114.66 0 top
R30388  10K  [0201]  209.45,115.27 0 top
R30389  10K  [0201]  209.45,115.87 0 top
R30390  10K  [0201]  209.45,116.48 0 top
R30391  10K  [0201]  209.45,117.09 0 top
R30392  10K  [0201]  209.45,117.7 0 top
R30393  10K  [0201]  209.45,118.31 0 top
R30394  10K  [0201]  209.45,118.92 0 top
R30395  10K  [0201]  209.45,119.53 0 top
R30396  10K  [0201]  209.45,120.14 0 top
R30397  10K  [0201]  209.45,120.75 0 top
R30398  10K  [0201]  209.45,121.36 0 top
R30399  10K  [0201]  209.45,121.97 0 top
R30400  10K  [0201]  209.45,122.58 0 top
R30401  10K  [0201]  210.67,1.27 0 top
R30402  10K  [0201]  210.67,1.88 0 top
R30403  10K  [0201]  210.67,2.49 0 top
R30404  10K  [0201]  210.67,3.1 0 top
R30405  10K  [0201]  210.67,3.71 0 top
R30406  10K  [0201]  210.67,4.32 0 top
R30407  10K  [0201]  210.67,4.93 0 top
R30408  10K  [0201]  210.67,5.54 0 top
R30409  10K  [0201]  210.67,6.15 0 top
R30410  10K  [0201]  210.67,6.76 0 top
R30411  10K  [0201]  210.67,7.37 0 top
R30412  10K  [0201]  210.67,7.98 0 top
R30413  10K  [0201]  210.67,8.59 0 top
R30414  10K  [0201]  210.67,9.19 0 top
R30415  10K  [0201]  210.67,9.8 0 top
R30416  10K  [0201]  210.67,10.41 0 top
R30417  10K  [0201]  210.67,11.02 0 top
R30418  10K  [0201]  210.67,11.63 0 top
R30419  10K  [0201]  210.67,12.24 0 top
R30420  10K  [0201]  210.67,12.85 0 top
R30421  10K  [0201]  210.67,13.46 0 top
R30422  10K  [0201]  210.67,14.07 0 top
R30423  10K  [0201]  210.67,14.68 0 top
R30424  10K  [0201]  210.67,15.29 0 top
R30425  10K  [0201]  210.67,15.9 0 top
R30426  10K  [0201]  210.67,16.51 0 top
R30427  10K  [0201]  210.67,17.12 0 top
R30428  10K  [0201]  210.67,17.73 0 top
R30429  10K  [0201]  210.67,18.34 0 top
R30430  10K  [0201]  210.67,18.95 0 top
R30431  10K  [0201]  210.67,19.56 0 top
R30432  10K  [0201]  210.67,20.17 0 top
R30433  10K  [0201]  210.67,20.78 0 top
R30434  10K  [0201]  210.67,21.39 0 top
R30435  10K  [0201]  210.67,22 0 top
R30436  10K  [0201]  210.67,22.61 0 top
R30437  10K  [0201]  210.67,23.22 0 top
R30438  10K  [0201]  210.67,23.83 0 top
R30439  10K  [0201]  210.67,24.43 0 top
R30440  10K  [0201]  210.67,25.04 0 top
R30441  10K  [0201]  210.67,25.65 0 top
R30442  10K  [0201]  210.67,26.26 0 top
R30443  10K  [0201]  210.67,26.87 0 top
R30444  10K  [0201]  210.67,27.48 0 top
R30445  10K  [0201]  210.67,28.09 0 top
R30446  10K  [0201]  210.67,28.7 0 top
R30447  10K  [0201]  210.67,29.31 0 top
R30448  10K  [0201]  210.67,29.92 0 top
R30449  10K  [0201]  210.67,30.53 0 top
R30450  10K  [0201]  210.67,31.14 0 top
R30451  10K  [0201]  210.67,31.75 0 top
R30452  10K  [0201]  210.67,32.36 0 top
R30453  10K  [0201]  210.67,32.97 0 top
R30454  10K  [0201]  210.67,33.58 0 top